# EAGLE board BMS-HVver2.0 (EAGLE 7.6.0), part 1 of 2
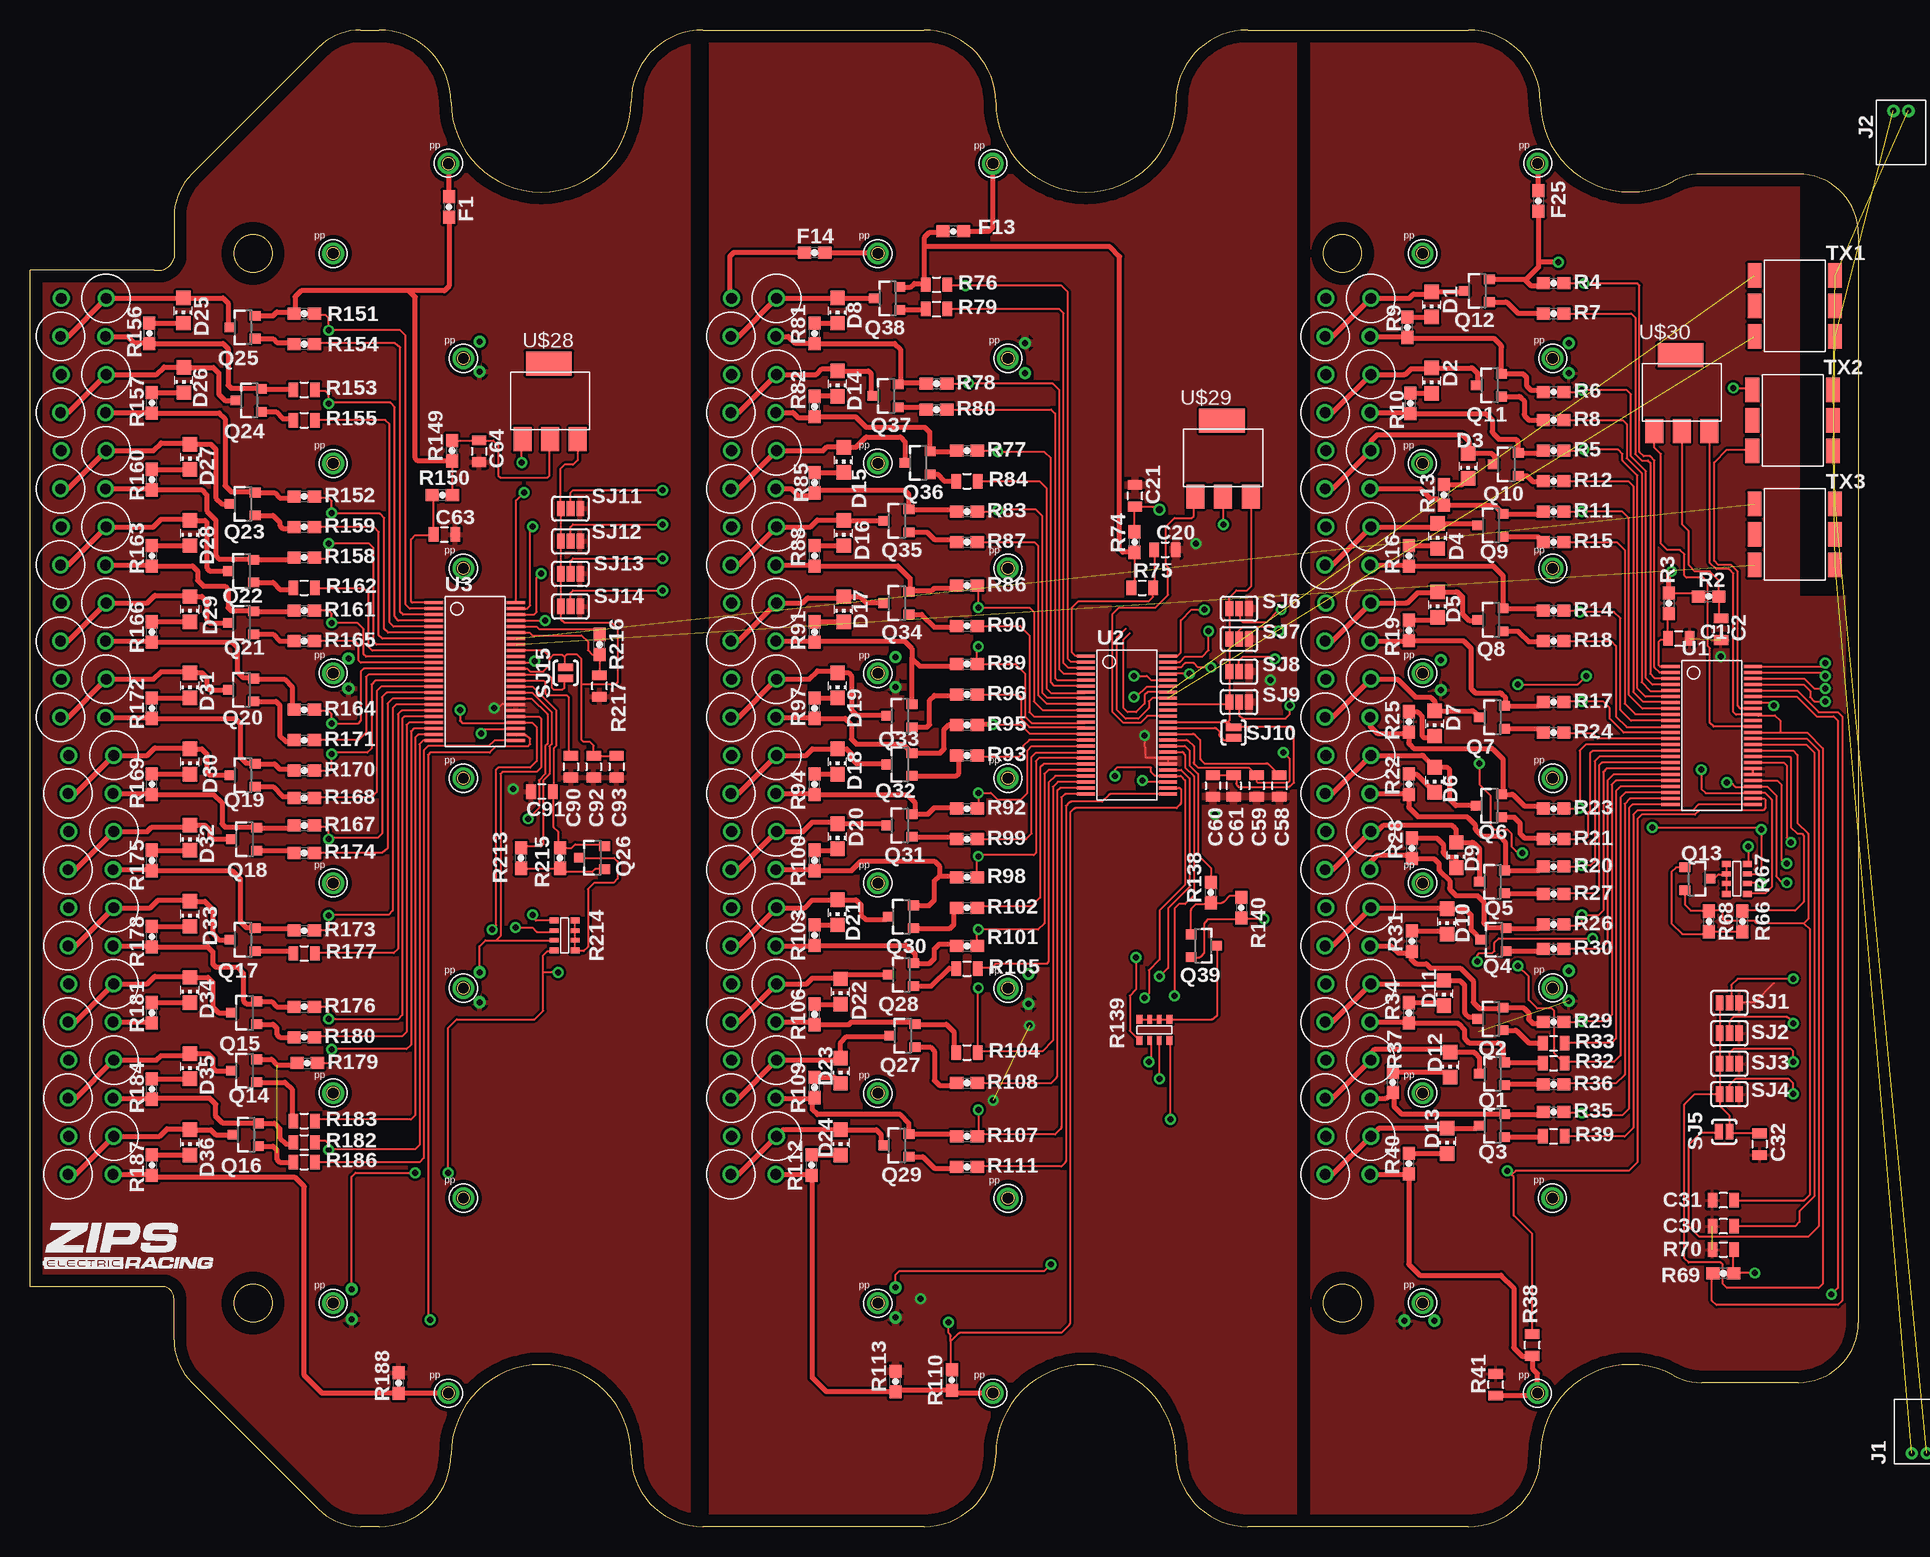
[diagram p3: board, top side]
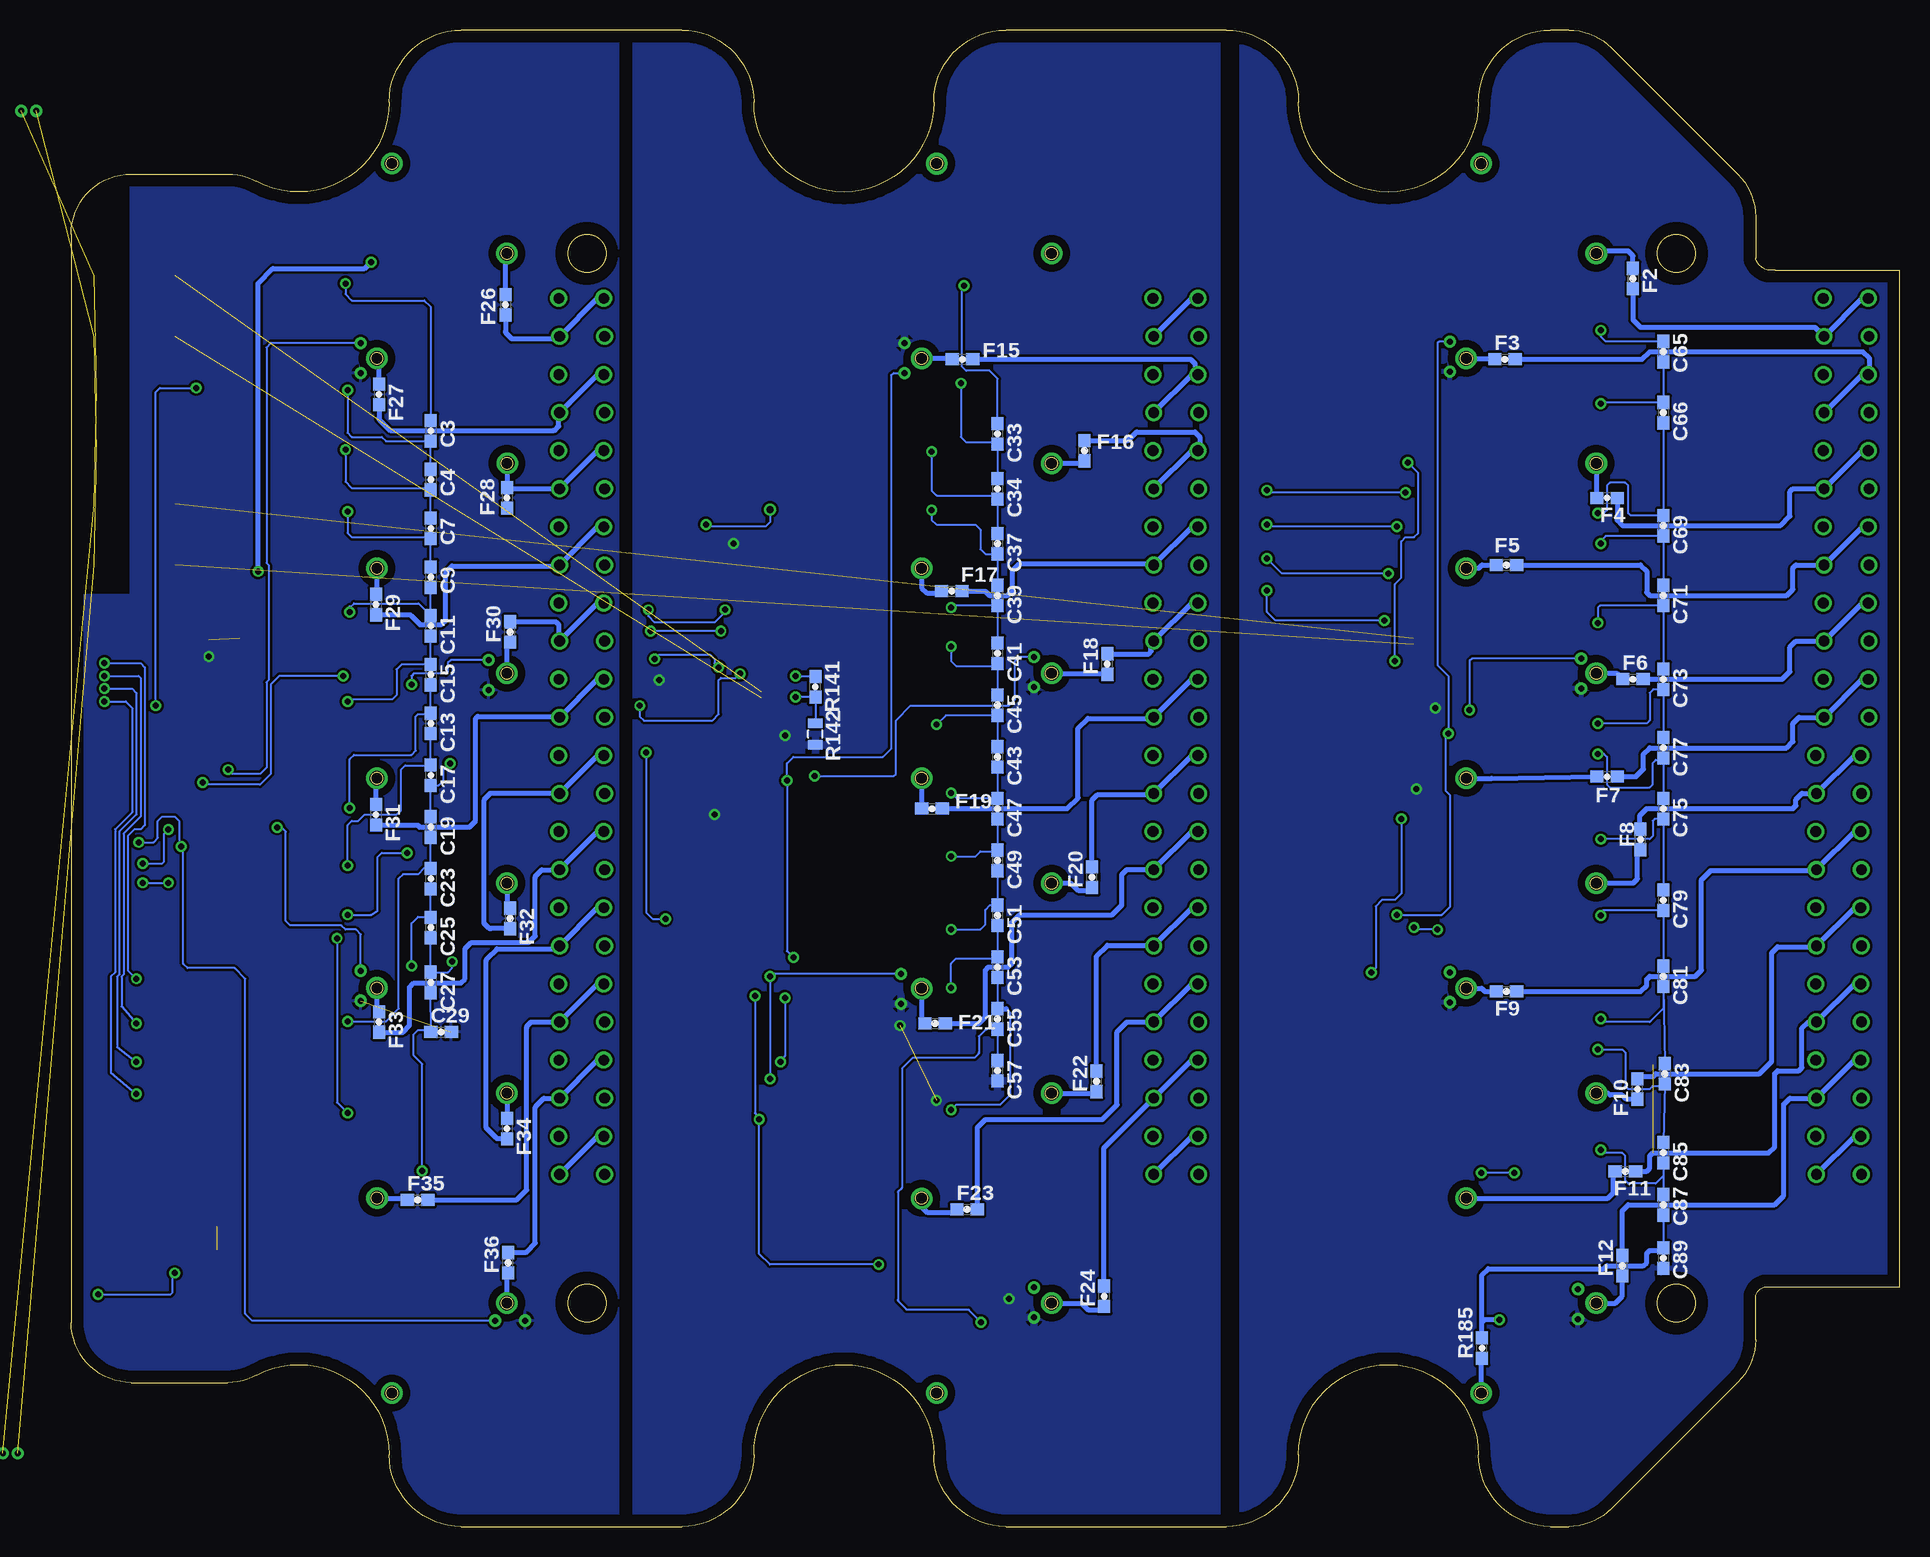
[diagram p4: board, bottom side, seen from below]

Size 152.4 x 124.75 mm. Coordinates in mm from the lower left corner, seen from the top.
Outline: 152.4,107.75 152.4,17 arc-90 147.4,12 139.34,12 arc-28 136.96,12.6 arc118 125.9,6 arc-90 119.9,0 101.5,0 arc-90 95.5,6 arc180 80.5,6 arc-90 74.5,0 56.1,0 arc-90 50.1,6 arc180 35.1,6 arc-90 29.1,0 27.57,0 arc-45 24.04,1.46 13.46,12.03 arc-45 12,15.57 12,19 arc90 11,20 0,20 0,104.75 10.37,104.75 arc90 12,105.75 12,109.18 arc-45 13.46,112.72 24.04,123.29 arc-45 27.57,124.75 29.1,124.75 arc-90 35.1,118.75 arc180 50.1,118.75 arc-90 56.1,124.75 74.5,124.75 arc-90 80.5,118.75 arc180 95.5,118.75 arc-90 101.5,124.75 119.9,124.75 arc-90 125.9,118.75 arc118 136.96,112.15 arc-28 139.34,112.75 147.4,112.75 arc-90 152.4,107.75
Outline: circle at 116.08,53.62 radius 0.5
Outline: circle at 126.92,62.38 radius 0.5
Outline: circle at 25.28,18.62 radius 0.5
Outline: circle at 25.28,36.12 radius 0.5
Outline: circle at 25.28,53.62 radius 0.5
Outline: circle at 70.68,18.62 radius 0.5
Outline: circle at 70.68,36.12 radius 0.5
Outline: circle at 70.68,53.62 radius 0.5
Outline: circle at 116.08,18.62 radius 0.5
Outline: circle at 36.12,27.38 radius 0.5
Outline: circle at 36.12,44.88 radius 0.5
Outline: circle at 36.12,62.38 radius 0.5
Outline: circle at 81.52,27.38 radius 0.5
Outline: circle at 81.52,44.88 radius 0.5
Outline: circle at 81.52,62.38 radius 0.5
Outline: circle at 126.92,27.38 radius 0.5
Outline: circle at 116.08,53.62 radius 0.5
Outline: circle at 126.92,62.38 radius 0.5
Outline: circle at 126.92,44.88 radius 0.5
Outline: circle at 116.08,36.12 radius 0.5
Copper layers (1*16): Top 0.035mm / dielectric 1.5mm / Bottom 0.035mm
Design rules "default": minimum track width 10mil, minimum drill 24mil, track to track 8mil, track to pad 8mil, pad to pad 8mil, via to via 8mil, smd to smd 8mil, copper to edge 40mil, drill to drill 8mil, minimum pad ring 10mil, minimum via ring 8mil, stop-mask expansion 4mil, vias tented up to drill 0mil, thermal gap 10mil

## Footprints (pad centres in the part's own frame; a part is rotated, then mirrored left to right if it is on the bottom)
0805 = smd 0.8 x 1.2: 1 -0.9,0; 2 0.9,0
0603 = smd 1.1 x 1: 1 -0.85,0; 2 0.85,0
CHIP_LED0805 = smd 1.2 x 1.2: A 0,-1.05; C 0,1.05
DF13-2P = drill 0.5: 1 -0.625,0; 2 0.625,0
SOT23 = smd 0.8 x 0.9: 1 -0.95,-1; 2 0.95,-1; 3 0,1.1
RR02J16RTB = drill 0.9: P$1 -3.75,0; P$2 0,0
MNR14 = smd 0.5 x 0.75: 1 -1.25,-0.9; 4 1.25,-0.9; 5 1.25,0.85; 8 -1.25,0.85 | smd 0.4 x 0.75: 2 -0.4,-0.9; 3 0.4,-0.9; 6 0.4,0.85; 7 -0.4,0.85
NTC-NXRT15XH103FA5B = drill 0.5: P$1 0,0; P$2 2.5,0
PAD-JUMPER-3-NO_YES_SILK = smd 0.635 x 1.27: 1 -0.813,0; 2 0,0; 3 0.813,0
PAD-JUMPER-2-NO_YES_SILK = smd 0.635 x 1.27: 1 -0.45,0; 2 0.45,0
PE-68386NLT = smd 1.143 x 2.032: 1 -3.378,2.54; 2 -3.378,0; 3 -3.378,-2.54; 4 3.353,-2.54; 5 3.353,0; 6 3.353,2.54
SSOP-48 = smd 0.25 x 1.524: 1 -5.75,-3.421; 2 -5.25,-3.421; 3 -4.75,-3.421; 4 -4.25,-3.421; 5 -3.75,-3.421; 6 -3.25,-3.421; 7 -2.75,-3.421; 8 -2.25,-3.421; 9 -1.75,-3.421; 10 -1.25,-3.421; 11 -0.75,-3.421; 12 -0.25,-3.421; 13 0.25,-3.421; 14 0.75,-3.421; 15 1.25,-3.421; 16 1.75,-3.421; 17 2.25,-3.421; 18 2.75,-3.421; 19 3.25,-3.421; 20 3.75,-3.421; 21 4.25,-3.421; 22 4.75,-3.421; 23 5.25,-3.421; 24 5.75,-3.421; 25 5.75,3.421; 26 5.25,3.421; 27 4.75,3.421; 28 4.25,3.421; 29 3.75,3.421; 30 3.25,3.421; 31 2.75,3.421; 32 2.25,3.421; 33 1.75,3.421; 34 1.25,3.421; 35 0.75,3.421; 36 0.25,3.421; 37 -0.25,3.421; 38 -0.75,3.421; 39 -1.25,3.421; 40 -1.75,3.421; 41 -2.25,3.421; 42 -2.75,3.421; 43 -3.25,3.421; 44 -3.75,3.421; 45 -4.25,3.421; 46 -4.75,3.421; 47 -5.25,3.421; 48 -5.75,3.421
POGOPIN = drill 1.2: 1 0,0
SOT223 = smd 1.5 x 2: P$1 0,0; P$2 2.3,0; P$3 4.6,0 | smd 3.8 x 2: P$4 2.2,6.3

## Placement (x,y rotation side)
C1  0.1UF  [0805]  137.44,74.03 0 top
C2  0.1UF  [0805]  140.94,74.8 270 top
C3  10NF  [0603]  122.43,91.33 270 bottom
C4  10NF  [0603]  122.43,87.27 270 bottom
C7  10NF  [0603]  122.43,83.2 270 bottom
C9  10NF  [0603]  122.43,79.14 270 bottom
C11  10NF  [0603]  122.43,75.08 270 bottom
C13  10NF  [0603]  122.43,66.95 270 bottom
C15  10NF  [0603]  122.43,71.01 270 bottom
C17  10NF  [0603]  122.43,62.63 270 bottom
C19  10NF  [0603]  122.43,58.31 270 bottom
C20  0.1UF  [0805]  94.62,81.42 0 top
C21  0.1UF  [0805]  92.1,85.92 90 top
C23  10NF  [0603]  122.43,53.99 270 bottom
C25  10NF  [0603]  122.43,49.93 270 bottom
C27  10NF  [0603]  122.43,45.36 270 bottom
C29  10NF  [0603]  121.56,41.22 0 bottom
C30  1UF  [0805]  141.15,25.04 180 top
C31  1UF  [0805]  141.15,27.2 180 top
C32  1UF  [0805]  144.17,31.87 270 top
C33  10NF  [0603]  75.18,91.08 270 bottom
C34  10NF  [0603]  75.18,86.5 270 bottom
C37  10NF  [0603]  75.18,81.93 270 bottom
C39  10NF  [0603]  75.18,77.61 270 bottom
C41  10NF  [0603]  75.18,72.79 270 bottom
C43  10NF  [0603]  75.18,64.15 270 bottom
C45  10NF  [0603]  75.18,68.47 270 bottom
C47  10NF  [0603]  75.18,59.84 270 bottom
C49  10NF  [0603]  75.18,55.52 270 bottom
C51  10NF  [0603]  75.18,50.95 270 bottom
C53  10NF  [0603]  75.18,46.63 270 bottom
C55  10NF  [0603]  75.18,42.31 270 bottom
C57  10NF  [0603]  75.18,37.99 270 bottom
C58  1UF  [0805]  104.14,61.74 270 top
C59  1UF  [0805]  102.23,61.74 270 top
C60  1UF  [0805]  98.6,61.74 270 top
C61  1UF  [0805]  100.33,61.74 270 top
C63  0.1UF  [0805]  34.54,82.69 0 top
C64  0.1UF  [0805]  37.44,89.63 270 top
C65  10NF  [0603]  19.69,97.94 270 bottom
C66  10NF  [0603]  19.69,92.86 270 bottom
C69  10NF  [0603]  19.69,83.43 270 bottom
C71  10NF  [0603]  19.69,77.61 270 bottom
C73  10NF  [0603]  19.69,70.63 270 bottom
C75  10NF  [0603]  19.69,59.84 270 bottom
C77  10NF  [0603]  19.69,64.92 270 bottom
C79  10NF  [0603]  19.69,52.22 270 bottom
C81  10NF  [0603]  19.69,45.86 270 bottom
C83  10NF  [0603]  19.56,37.74 270 bottom
C85  10NF  [0603]  19.69,31.16 270 bottom
C87  10NF  [0603]  19.69,26.81 270 bottom
C89  10NF  [0603]  19.69,22.37 270 bottom
C90  1UF  [0805]  45.09,63.34 270 top
C91  1UF  [0805]  42.67,61.26 180 top
C92  1UF  [0805]  46.99,63.34 270 top
C93  1UF  [0805]  48.9,63.34 270 top
D1  LED_RED  [CHIP_LED0805]  116.84,101.87 180 top
D2  LED_RED  [CHIP_LED0805]  116.84,95.52 180 top
D3  LED_RED  [CHIP_LED0805]  119.89,88.41 180 top
D4  LED_RED  [CHIP_LED0805]  117.35,82.57 180 top
D5  LED_RED  [CHIP_LED0805]  117.35,76.85 180 top
D6  LED_RED  [CHIP_LED0805]  117.09,62.25 180 top
D7  LED_RED  [CHIP_LED0805]  117.09,66.95 180 top
D8  LED_RED  [CHIP_LED0805]  67.31,101.36 180 top
D9  LED_RED  [CHIP_LED0805]  118.9,55.97 180 top
D10  LED_RED  [CHIP_LED0805]  118.11,50.44 180 top
D11  LED_RED  [CHIP_LED0805]  117.86,44.47 180 top
D12  LED_RED  [CHIP_LED0805]  118.36,38.5 180 top
D13  LED_RED  [CHIP_LED0805]  118.11,32.15 180 top
D14  LED_RED  [CHIP_LED0805]  67.31,95.27 180 top
D15  LED_RED  [CHIP_LED0805]  67.82,88.92 180 top
D16  LED_RED  [CHIP_LED0805]  67.82,82.82 180 top
D17  LED_RED  [CHIP_LED0805]  67.82,76.47 180 top
D18  LED_RED  [CHIP_LED0805]  67.31,63.77 180 top
D19  LED_RED  [CHIP_LED0805]  67.31,70.12 180 top
D20  LED_RED  [CHIP_LED0805]  67.31,57.55 180 top
D21  LED_RED  [CHIP_LED0805]  67.31,51.2 180 top
D22  LED_RED  [CHIP_LED0805]  67.56,44.59 180 top
D23  LED_RED  [CHIP_LED0805]  67.56,37.99 180 top
D24  LED_RED  [CHIP_LED0805]  67.56,32.02 180 top
D25  LED_RED  [CHIP_LED0805]  12.78,101.36 180 top
D26  LED_RED  [CHIP_LED0805]  12.83,95.57 180 top
D27  LED_RED  [CHIP_LED0805]  13.34,89.17 180 top
D28  LED_RED  [CHIP_LED0805]  13.34,82.82 180 top
D29  LED_RED  [CHIP_LED0805]  13.34,76.47 180 top
D30  LED_RED  [CHIP_LED0805]  13.34,63.77 180 top
D31  LED_RED  [CHIP_LED0805]  13.34,70.12 180 top
D32  LED_RED  [CHIP_LED0805]  13.34,57.42 180 top
D33  LED_RED  [CHIP_LED0805]  13.34,51.07 180 top
D34  LED_RED  [CHIP_LED0805]  13.34,44.72 180 top
D35  LED_RED  [CHIP_LED0805]  13.34,38.37 180 top
D36  LED_RED  [CHIP_LED0805]  13.34,32.02 180 top
F1  FUSE_750MA_63V_0603  [0603]  34.93,110 270 top
F2  FUSE_750MA_63V_0603  [0603]  22.23,104.03 270 bottom
F3  FUSE_750MA_63V_0603  [0603]  32.89,97.3 0 bottom
F4  FUSE_750MA_63V_0603  [0603]  24.38,85.74 0 bottom
F5  FUSE_750MA_63V_0603  [0603]  32.77,80.16 0 bottom
F6  FUSE_750MA_63V_0603  [0603]  22.23,70.63 0 bottom
F7  FUSE_750MA_63V_0603  [0603]  24.38,62.5 0 bottom
F8  FUSE_750MA_63V_0603  [0603]  21.59,57.27 90 bottom
F9  FUSE_750MA_63V_0603  [0603]  32.77,44.59 0 bottom
F10  FUSE_750MA_63V_0603  [0603]  21.84,36.47 90 bottom
F11  FUSE_750MA_63V_0603  [0603]  22.86,29.61 0 bottom
F12  FUSE_750MA_63V_0603  [0603]  23.11,21.73 90 bottom
F13  FUSE_750MA_63V_0603  [0603]  76.96,107.97 180 top
F14  FUSE_750MA_63V_0603  [0603]  65.41,106.19 180 top
F15  FUSE_750MA_63V_0603  [0603]  78.11,97.3 0 bottom
F16  FUSE_750MA_63V_0603  [0603]  67.95,89.68 90 bottom
F17  FUSE_750MA_63V_0603  [0603]  78.99,77.97 0 bottom
F18  FUSE_750MA_63V_0603  [0603]  66.04,71.9 90 bottom
F19  FUSE_750MA_63V_0603  [0603]  80.65,59.84 0 bottom
F20  FUSE_750MA_63V_0603  [0603]  67.31,54.12 90 bottom
F21  FUSE_750MA_63V_0603  [0603]  80.39,41.93 0 bottom
F22  FUSE_750MA_63V_0603  [0603]  66.93,37.1 90 bottom
F23  FUSE_750MA_63V_0603  [0603]  77.72,26.43 0 bottom
F24  FUSE_750MA_63V_0603  [0603]  66.29,19.2 90 bottom
F25  FUSE_750MA_63V_0603  [0603]  125.73,110.51 270 top
F26  FUSE_750MA_63V_0603  [0603]  116.21,101.85 270 bottom
F27  FUSE_750MA_63V_0603  [0603]  126.75,94.38 270 bottom
F28  FUSE_750MA_63V_0603  [0603]  116.08,85.74 270 bottom
F29  FUSE_750MA_63V_0603  [0603]  127,76.85 270 bottom
F30  FUSE_750MA_63V_0603  [0603]  115.82,74.57 90 bottom
F31  FUSE_750MA_63V_0603  [0603]  127,59.33 270 bottom
F32  FUSE_750MA_63V_0603  [0603]  115.82,50.69 270 bottom
F33  FUSE_750MA_63V_0603  [0603]  126.75,42.05 270 bottom
F34  FUSE_750MA_63V_0603  [0603]  116.08,33.16 270 bottom
F35  FUSE_750MA_63V_0603  [0603]  123.52,27.22 0 bottom
F36  FUSE_750MA_63V_0603  [0603]  115.98,21.99 90 bottom
J1  M2_DF13-2P  [DF13-2P]  157.48,6.11 0 top  (outside the outline)
J2  M2_DF13-2P  [DF13-2P]  155.96,118 180 top
Q1  BSS308PE  [SOT23]  121.92,37.74 90 top
Q2  BSS308PE  [SOT23]  121.79,42.31 90 top
Q3  BSS308PE  [SOT23]  121.92,33.42 90 top
Q4  BSS308PE  [SOT23]  122.05,48.91 90 top
Q5  BSS308PE  [SOT23]  121.92,53.74 90 top
Q6  BSS308PE  [SOT23]  121.67,60.09 90 top
Q7  BSS308PE  [SOT23]  121.92,67.45 90 top
Q8  BSS308PE  [SOT23]  121.79,75.58 90 top
Q9  BSS308PE  [SOT23]  121.79,83.46 90 top
Q10  BSS308PE  [SOT23]  123.06,88.54 90 top
Q11  BSS308PE  [SOT23]  121.67,95.14 90 top
Q12  BSS308PE  [SOT23]  120.65,103.02 90 top
Q13  BSS308PE  [SOT23]  138.94,53.99 270 top
Q14  BSS308PE  [SOT23]  17.91,37.99 90 top
Q15  BSS308PE  [SOT23]  17.91,42.82 90 top
Q16  BSS308PE  [SOT23]  18.03,32.66 90 top
Q17  BSS308PE  [SOT23]  17.78,48.91 90 top
Q18  BSS308PE  [SOT23]  17.91,57.3 90 top
Q19  BSS308PE  [SOT23]  17.78,62.63 90 top
Q20  BSS308PE  [SOT23]  17.65,69.74 90 top
Q21  BSS308PE  [SOT23]  17.65,75.33 90 top
Q22  BSS308PE  [SOT23]  17.65,79.65 90 top
Q23  BSS308PE  [SOT23]  17.78,85.23 90 top
Q24  BSS308PE  [SOT23]  18.29,93.87 90 top
Q25  BSS308PE  [SOT23]  17.78,99.97 90 top
Q26  BSS308PE  [SOT23]  46.89,55.75 90 top
Q27  BSS308PE  [SOT23]  72.77,40.91 90 top
Q28  BSS308PE  [SOT23]  72.64,45.99 90 top
Q29  BSS308PE  [SOT23]  72.26,31.77 90 top
Q30  BSS308PE  [SOT23]  72.64,50.82 90 top
Q31  BSS308PE  [SOT23]  72.52,58.44 90 top
Q32  BSS308PE  [SOT23]  72.52,63.52 90 top
Q33  BSS308PE  [SOT23]  72.52,67.58 90 top
Q34  BSS308PE  [SOT23]  72.26,76.98 90 top
Q35  BSS308PE  [SOT23]  72.26,83.84 90 top
Q36  BSS308PE  [SOT23]  74.04,88.66 90 top
Q37  BSS308PE  [SOT23]  71.37,94.25 90 top
Q38  BSS308PE  [SOT23]  71.5,102.38 90 top
Q39  BSS308PE  [SOT23]  97.79,48.41 270 top
R2  100  [0603]  139.93,77.54 0 top
R3  100  [0603]  136.6,76.95 270 top
R4  100  [0603]  127,103.65 0 top
R5  100  [0603]  127,89.68 0 top
R6  100  [0603]  127,94.58 0 top
R7  3.3K  [0603]  127,101.11 0 top
R8  3.3K  [0603]  127,92.22 0 top
R9  475  [0603]  114.81,99.97 90 top
R10  475  [0603]  115.06,93.62 90 top
R11  100  [0603]  127,84.6 0 top
R12  3.3K  [0603]  127,87.14 0 top
R13  475  [0603]  117.86,86 90 top
R14  100  [0603]  127,76.34 0 top
R15  3.3K  [0603]  127,82.06 0 top
R16  475  [0603]  114.94,80.92 90 top
R17  100  [0603]  127,68.72 0 top
R18  3.3K  [0603]  127,73.81 0 top
R19  475  [0603]  114.94,74.69 90 top
R20  100  [0603]  127,55.01 0 top
R21  3.3K  [0603]  127,57.3 0 top
R22  475  [0603]  114.94,61.87 90 top
R23  100  [0603]  127,59.84 0 top
R24  3.3K  [0603]  127,66.19 0 top
R25  475  [0603]  114.94,67.07 90 top
R26  100  [0603]  127,50.18 0 top
R27  3.3K  [0603]  127,52.72 0 top
R28  475  [0603]  115.19,56.53 90 top
R29  100  [0603]  127,42.05 0 top
R30  3.3K  [0603]  127,48.15 0 top
R31  475  [0603]  115.19,48.79 90 top
R32  100  [0805]  127,38.63 0 top
R33  3.3K  [0805]  127,40.28 0 top
R34  475  [0603]  114.94,42.82 90 top
R35  100  [0603]  127,34.56 0 top
R36  3.3K  [0603]  127,36.85 0 top
R37  475  [0603]  113.59,37.03 90 top
R38  100  [0805]  125.22,15.13 90 top
R39  3.3K  [0805]  127,32.53 0 top
R40  475  [0603]  114.94,30.24 90 top
R41  0  [0805]  122.17,11.83 90 top
R42  16  [RR02J16RTB]  107.95,29.35 180 top
R43  16  [RR02J16RTB]  111.76,32.53 0 top
R44  16  [RR02J16RTB]  107.95,35.7 180 top
R45  16  [RR02J16RTB]  111.76,38.88 0 top
R46  16  [RR02J16RTB]  107.95,42.05 180 top
R47  16  [RR02J16RTB]  111.76,45.23 0 top
R48  16  [RR02J16RTB]  107.95,48.41 180 top
R49  16  [RR02J16RTB]  111.76,51.58 0 top
R50  16  [RR02J16RTB]  107.95,54.76 180 top
R51  16  [RR02J16RTB]  111.76,57.93 0 top
R52  16  [RR02J16RTB]  107.95,61.1 180 top
R53  16  [RR02J16RTB]  111.76,64.28 0 top
R54  16  [RR02J16RTB]  107.95,67.45 180 top
R55  16  [RR02J16RTB]  111.76,70.63 0 top
R56  16  [RR02J16RTB]  107.95,73.81 180 top
R57  16  [RR02J16RTB]  111.76,76.98 0 top
R58  16  [RR02J16RTB]  107.95,80.16 180 top
R59  16  [RR02J16RTB]  111.76,83.33 0 top
R60  16  [RR02J16RTB]  107.95,86.5 180 top
R61  16  [RR02J16RTB]  111.76,89.68 0 top
R62  16  [RR02J16RTB]  107.95,92.86 180 top
R63  16  [RR02J16RTB]  111.76,96.03 0 top
R64  16  [RR02J16RTB]  107.95,99.2 180 top
R65  16  [RR02J16RTB]  111.76,102.38 0 top
R66  1K  [0603]  142.75,50.44 90 top
R67  10K  [MNR14]  142.24,53.99 90 top
R68  100K  [0603]  139.95,50.44 90 top
R69  1.2K  [0603]  141.15,21.1 180 top
R70  787  [0805]  141.15,23.08 0 top
R71  10K-NTC  [NTC-NXRT15XH103FA5B]  128.27,96.16 90 top
R72  10K-NTC  [NTC-NXRT15XH103FA5B]  117.6,69.74 90 top
R73  10K-NTC  [NTC-NXRT15XH103FA5B]  128.27,43.83 90 top
R74  100  [0603]  92.08,82.06 90 top
R75  100  [0805]  92.71,78.25 0 top
R76  100  [0805]  75.56,103.52 0 top
R77  100  [0603]  78.11,89.68 0 top
R78  100  [0603]  75.56,95.27 0 top
R79  3.3K  [0805]  75.56,101.49 0 top
R80  3.3K  [0603]  75.56,93.11 0 top
R81  475  [0603]  65.41,99.46 90 top
R82  475  [0603]  65.41,93.36 90 top
R83  100  [0603]  78.11,84.6 0 top
R84  3.3K  [0805]  78.11,87.14 0 top
R85  475  [0603]  65.41,87.01 90 top
R86  100  [0603]  78.11,78.43 0 top
R87  3.3K  [0603]  78.11,82.06 0 top
R88  475  [0603]  65.41,80.92 90 top
R89  100  [0603]  78.11,71.9 0 top
R90  3.3K  [0603]  78.11,75.08 0 top
R91  475  [0603]  65.41,74.57 90 top
R92  100  [0603]  78.11,59.84 0 top
R93  3.3K  [0603]  78.11,64.28 0 top
R94  475  [0603]  65.41,61.87 90 top
R95  100  [0603]  78.11,66.82 0 top
R96  3.3K  [0603]  78.11,69.36 0 top
R97  475  [0603]  65.41,68.22 90 top
R98  100  [0603]  78.11,54.12 0 top
R99  3.3K  [0603]  78.11,57.3 0 top
R100  475  [0603]  65.41,55.52 90 top
R101  100  [0603]  78.11,48.41 0 top
R102  3.3K  [0603]  78.11,51.58 0 top
R103  475  [0603]  65.41,49.29 90 top
R104  100  [0805]  78.11,39.52 0 top
R105  3.3K  [0805]  78.11,46.5 0 top
R106  475  [0603]  65.41,42.69 90 top
R107  100  [0603]  78.11,32.53 0 top
R108  3.3K  [0603]  78.11,36.98 0 top
R109  475  [0603]  65.41,36.59 90 top
R110  100  [0603]  76.84,12.21 90 top
R111  3.3K  [0603]  78.11,29.99 0 top
R112  475  [0603]  65.15,30.12 90 top
R113  0  [0603]  72.14,12.08 90 top
R114  16  [RR02J16RTB]  58.42,29.35 180 top
R115  16  [RR02J16RTB]  62.23,32.53 0 top
R116  16  [RR02J16RTB]  58.42,35.7 180 top
R117  16  [RR02J16RTB]  62.23,38.88 0 top
R118  16  [RR02J16RTB]  58.42,42.05 180 top
R119  16  [RR02J16RTB]  62.23,45.23 0 top
R120  16  [RR02J16RTB]  58.42,48.41 180 top
R121  16  [RR02J16RTB]  62.23,51.58 0 top
R122  16  [RR02J16RTB]  58.42,54.76 180 top
R123  16  [RR02J16RTB]  62.23,57.93 0 top
R124  16  [RR02J16RTB]  58.42,61.1 180 top
R125  16  [RR02J16RTB]  62.23,64.28 0 top
R126  16  [RR02J16RTB]  58.42,67.45 180 top
R127  16  [RR02J16RTB]  62.23,70.63 0 top
R128  16  [RR02J16RTB]  58.42,73.81 180 top
R129  16  [RR02J16RTB]  62.23,76.98 0 top
R130  16  [RR02J16RTB]  58.42,80.16 180 top
R131  16  [RR02J16RTB]  62.23,83.33 0 top
R132  16  [RR02J16RTB]  58.42,86.5 180 top
R133  16  [RR02J16RTB]  62.23,89.68 0 top
R134  16  [RR02J16RTB]  58.42,92.86 180 top
R135  16  [RR02J16RTB]  62.23,96.03 0 top
R136  16  [RR02J16RTB]  58.42,99.2 180 top
R137  16  [RR02J16RTB]  62.23,102.38 0 top
R138  1K  [0603]  98.43,52.85 90 top
R139  10K  [MNR14]  93.73,41.42 0 top
R140  100K  [0603]  100.97,51.58 270 top
R141  1.2K  [0603]  90.37,70 90 bottom
R142  787  [0805]  90.37,66.06 90 bottom
R143  10K-NTC  [NTC-NXRT15XH103FA5B]  82.93,98.65 270 top
R144  10K-NTC  [NTC-NXRT15XH103FA5B]  72.14,70 90 top
R145  10K-NTC  [NTC-NXRT15XH103FA5B]  83.24,43.58 90 top
R146  10K-NTC  [NTC-NXRT15XH103FA5B]  72.14,17.42 90 top
R147  10K-NTC  [NTC-NXRT15XH103FA5B]  114.55,17.16 0 top
R149  100  [0603]  35.18,89.68 90 top
R150  100  [0603]  34.37,85.97 180 top
R151  100  [0603]  22.86,101.11 0 top
R152  100  [0603]  22.86,85.87 0 top
R153  100  [0805]  22.86,94.76 0 top
R154  3.3K  [0603]  22.86,98.57 0 top
R155  3.3K  [0805]  22.86,92.22 0 top
R156  475  [0603]  9.96,99.46 90 top
R157  475  [0603]  10.16,93.67 90 top
R158  100  [0603]  22.86,80.79 0 top
R159  3.3K  [0603]  22.86,83.33 0 top
R160  475  [0603]  10.16,87.27 90 top
R161  100  [0603]  22.86,76.34 0 top
R162  3.3K  [0805]  22.86,78.25 0 top
R163  475  [0603]  10.16,80.92 90 top
R164  100  [0603]  22.86,68.09 0 top
R165  3.3K  [0603]  22.86,73.81 0 top
R166  475  [0603]  10.16,74.57 90 top
R167  100  [0603]  22.86,58.44 0 top
R168  3.3K  [0603]  22.86,60.72 0 top
R169  475  [0603]  10.16,61.87 90 top
R170  100  [0603]  22.86,63.01 0 top
R171  3.3K  [0603]  22.86,65.55 0 top
R172  475  [0603]  10.16,68.22 90 top
R173  100  [0603]  22.86,49.67 0 top
R174  3.3K  [0603]  22.86,56.15 0 top
R175  475  [0603]  10.16,55.52 90 top
R176  100  [0603]  22.86,43.33 0 top
R177  3.3K  [0805]  22.86,47.77 0 top
R178  475  [0603]  10.16,49.17 90 top
R179  100  [0603]  23.11,38.63 0 top
R180  3.3K  [0603]  22.86,40.78 0 top
R181  475  [0603]  10.16,42.82 90 top
R182  100  [0805]  22.86,32.02 0 top
R183  3.3K  [0805]  22.86,33.8 0 top
R184  475  [0603]  10.16,36.47 90 top
R185  100  [0603]  34.8,14.88 90 bottom
R186  3.3K  [0805]  22.86,30.37 0 top
R187  475  [0603]  10.16,30.12 90 top